# EasyEDA Pro project 3SE_24_Power_Rune.eprj, board Armour (continued)
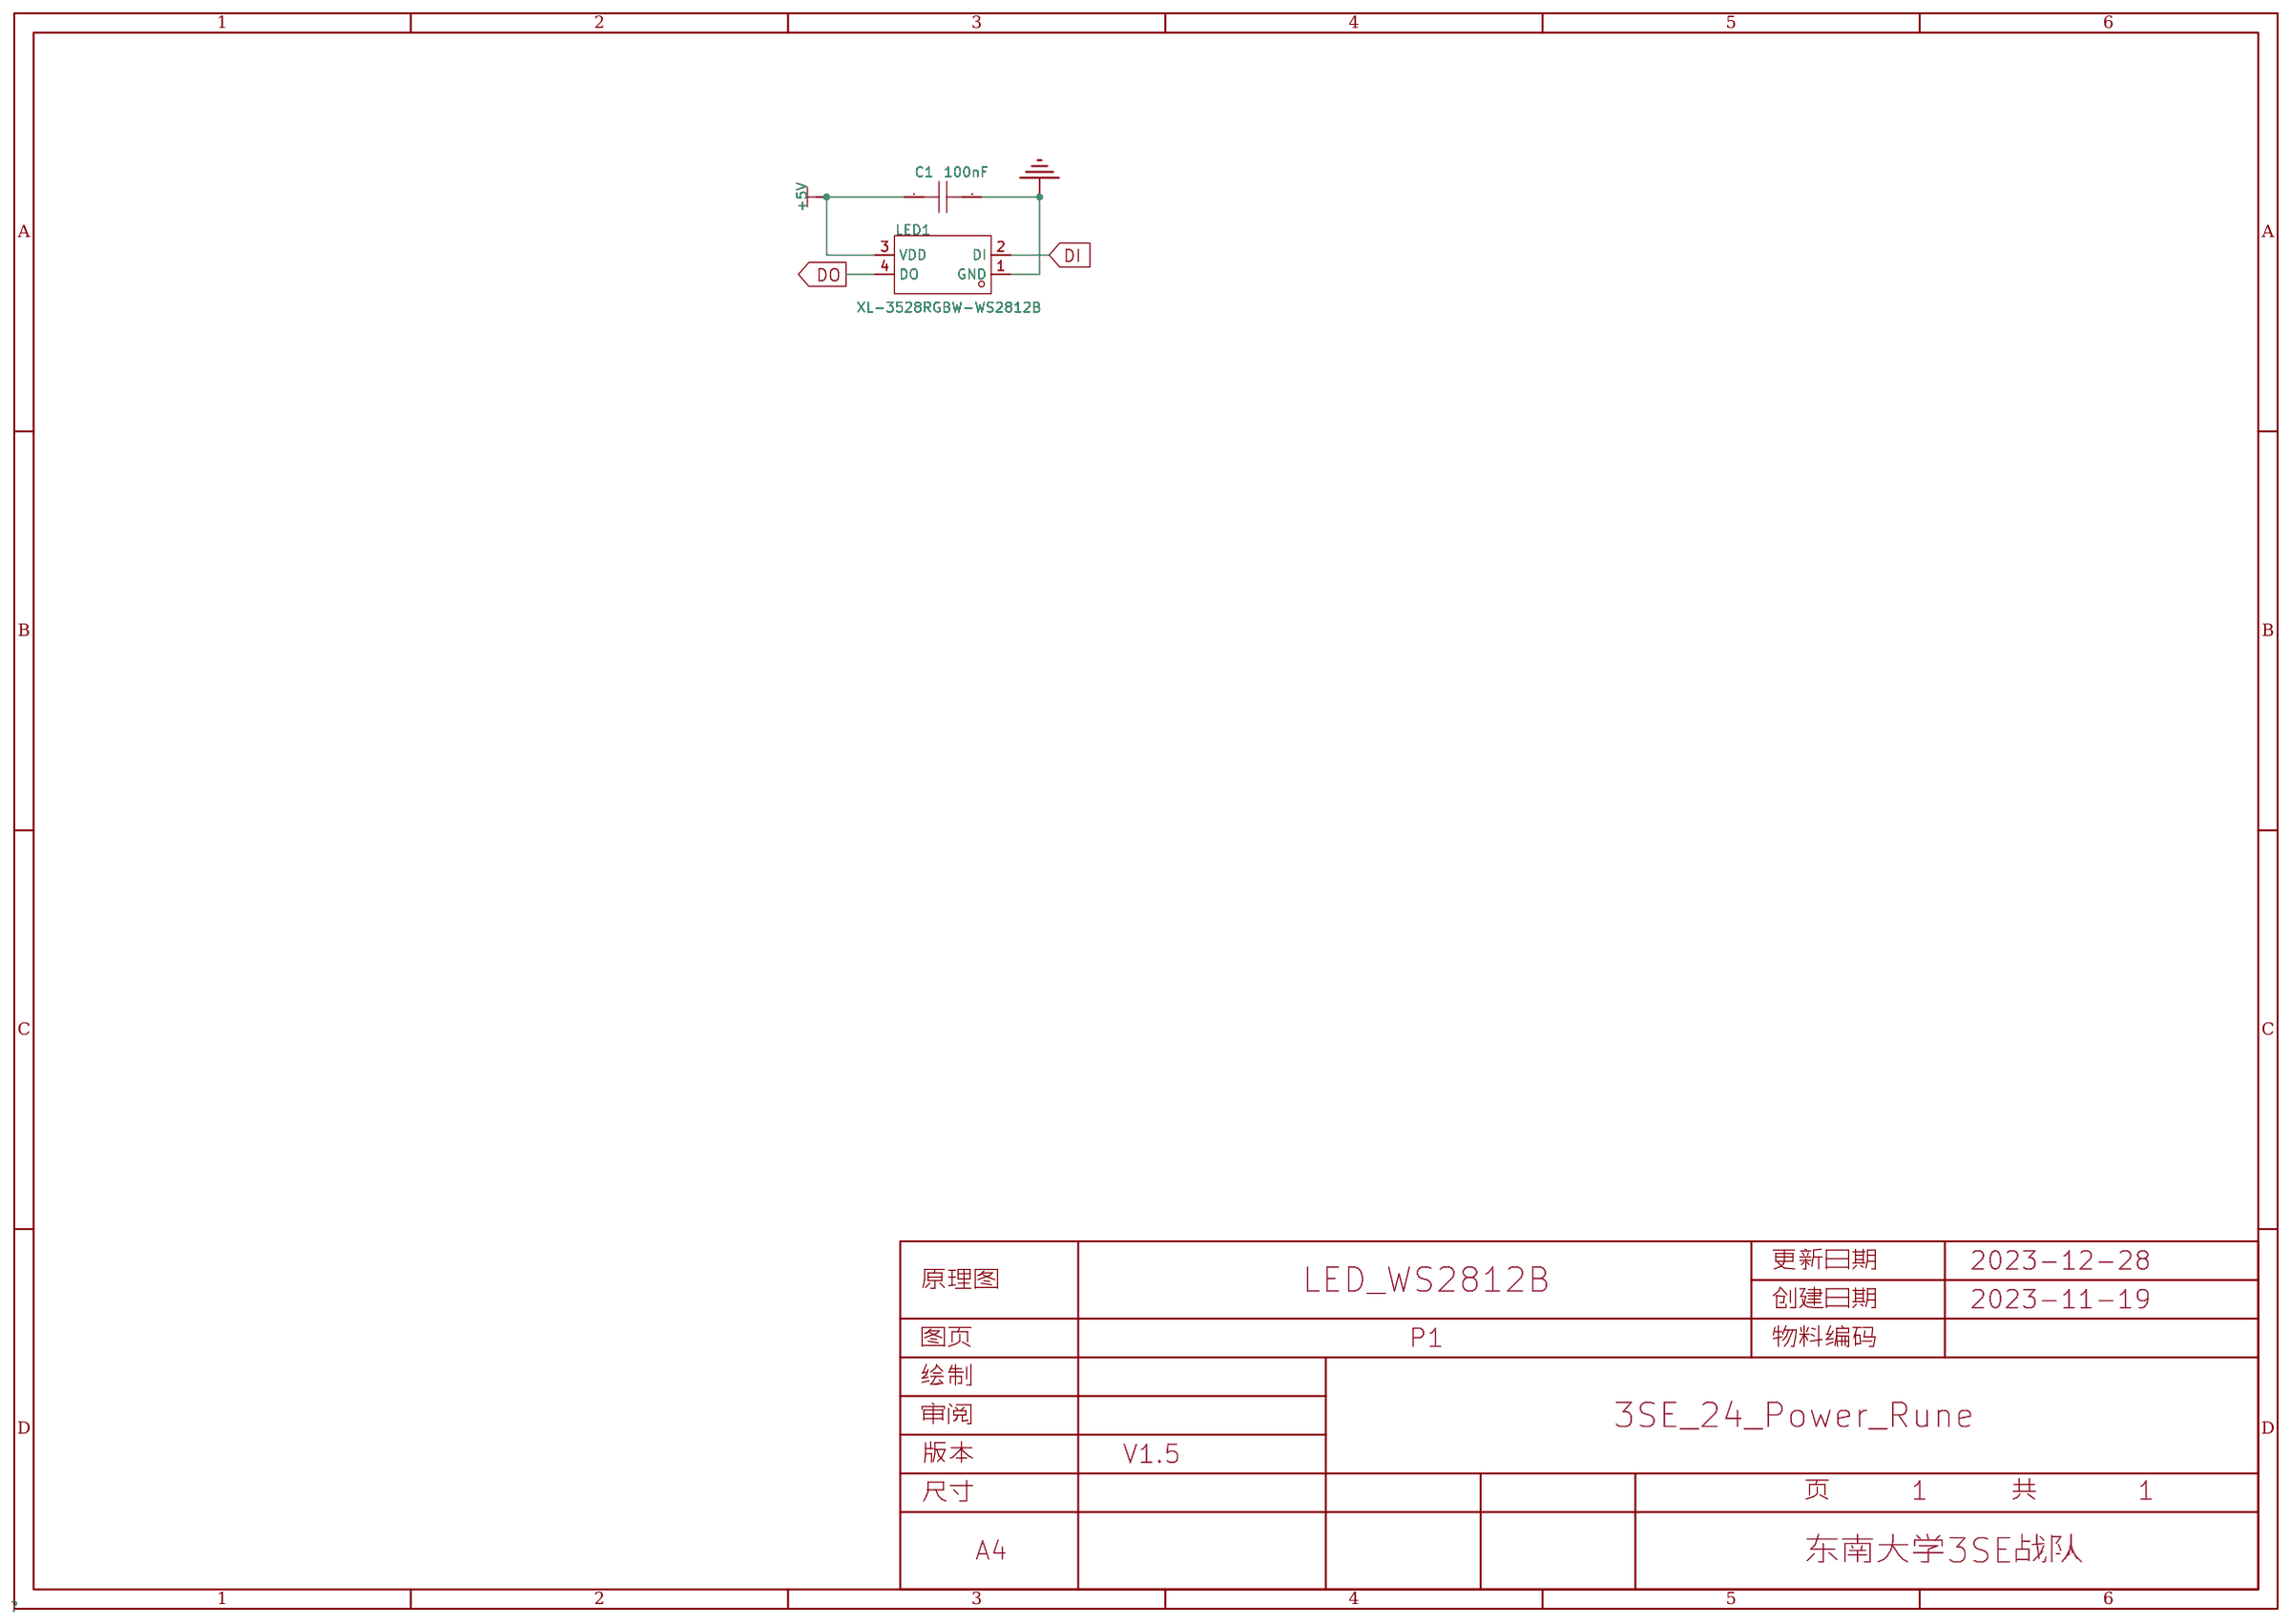
[diagram p0: schematic sheet]
## Nets (continued)
$1N31567: LED211.4 LED212.2
$1N31571: LED210.4 LED211.2
$1N31573: LED214.4 LED215.2
$1N31574: LED215.4 LED216.2
$1N31575: LED213.4 LED214.2
$1N31715: LED218.4 LED219.2
$1N31717: LED220.4 LED221.2
$1N31718: LED221.4 LED222.2
$1N31721: LED219.4 LED220.2
$1N31723: LED223.4 LED224.2
$1N31724: LED224.4 LED225.2
$1N31727: LED216.4 LED217.2
$1N31863: LED226.4 LED227.2
$1N31867: LED229.4 LED230.2
$1N31868: LED230.4 LED231.2
$1N31869: LED231.4 LED232.2
$1N31871: LED228.4 LED229.2
$1N31874: LED233.4 LED234.2
$1N31877: LED225.4 LED226.2
$1N32013: LED235.4 LED236.2
$1N32014: LED236.4 LED237.2
$1N32015: LED237.4 LED238.2
$1N32017: LED239.4 LED240.2
$1N32018: LED240.4 LED241.2
$1N32019: LED241.4 LED242.2
$1N32021: LED238.4 LED239.2
$1N32023: LED243.4 LED244.2
$1N32024: LED244.4 LED245.2
$1N32025: LED242.4 LED243.2
$1N32027: LED234.4 LED235.2
$1N32163: LED246.4 LED247.2
$1N32164: LED247.4 LED248.2
$1N32165: LED248.4 LED249.2
$1N32167: LED250.4 LED251.2
$1N32168: LED251.4 LED252.2
$1N32169: LED252.4 LED253.2
$1N32171: LED249.4 LED250.2
$1N32173: LED254.4 LED255.2
$1N32174: LED255.4 LED256.2
$1N32175: LED253.4 LED254.2
$1N32177: LED245.4 LED246.2
$1N32313: LED257.4 LED258.2
$1N32327: LED256.4 LED257.2
$1N36301: LED217.4 LED218.2
$1N36307: LED222.4 LED223.2
$1N36310: LED227.4 LED228.2
$1N36313: LED232.4 LED233.2
$1N36316: LED197.4 LED198.2
$1N36322: LED202.4 LED203.2
$1N36325: LED207.4 LED208.2
$1N36331: LED212.4 LED213.2
$1N36334: LED70.4 LED71.2
$1N36337: LED80.4 LED81.2
$1N36340: LED54.4 LED55.2
$1N36343: LED3.4 LED4.2
$1N36346: LED8.4 LED9.2
$1N36349: LED13.4 LED14.2
$1N36354: LED23.4 LED24.2
$1N36357: LED18.4 LED19.2
$1N36363: LED28.4 LED29.2
$1N36372: LED33.4 LED34.2
$1N36387: LED38.4 LED39.2
$11N923: R28.2 U3.15
$11N2441: C438.1 R1.1 R6.2 U1.2
$11N5632: C452.1 U3.8 X1.1
$11N5639: C454.1 U3.9 X1.2
$11N5674: SW3.2 U3.21
$11N5844: LED431.2 R30.1
$11N5848: LED431.1 U3.25
$11N11553: R32.2 USB1.4
$11N11554: R33.2 USB1.10
$11N31259: D2.2 L1.1 U1.3
$11N48563: C433.1 U1.4
$11N53990: D4.3 USB1.6 USB1.8
$11N54016: D4.1 USB1.5 USB1.7
$12N59: LED259.4 LED260.2
$12N73: LED260.4 LED261.2
$12N87: LED261.4 LED262.2
$12N101: LED262.4 LED263.2
$12N115: LED263.4 LED264.2
$12N129: LED264.4 LED265.2
$12N143: LED265.4 LED266.2
$12N157: LED266.4 LED267.2
$12N171: LED267.4 LED268.2
$12N306: LED269.4 LED270.2
$12N308: LED270.4 LED271.2
$12N310: LED271.4 LED272.2
$12N312: LED272.4 LED273.2
$12N314: LED273.4 LED274.2
$12N316: LED274.4 LED275.2
$12N318: LED275.4 LED276.2
$12N320: LED276.4 LED277.2
$12N322: LED277.4 LED278.2
$12N702: LED279.4 LED280.2
$12N704: LED280.4 LED281.2
$12N706: LED281.4 LED282.2
$12N708: LED282.4 LED283.2
$12N710: LED283.4 LED284.2
$12N712: LED284.4 LED285.2
$12N714: LED285.4 LED286.2
$12N716: LED286.4 LED287.2
$12N718: LED287.4 LED288.2
$12N720: LED289.4 LED290.2
$12N722: LED290.4 LED291.2
$12N724: LED291.4 LED292.2
$12N726: LED292.4 LED293.2
$12N728: LED293.4 LED294.2
$12N730: LED294.4 LED295.2
$12N732: LED295.4 LED296.2
$12N734: LED296.4 LED297.2
$12N736: LED297.4 LED298.2
$12N978: LED299.4 LED300.2
$12N980: LED300.4 LED301.2
$12N982: LED301.4 LED302.2
$12N984: LED302.4 LED303.2
$12N986: LED303.4 LED304.2
$12N988: LED304.4 LED305.2
$12N990: LED305.4 LED306.2
$12N992: LED306.4 LED307.2
$12N994: LED307.4 LED308.2
$12N996: LED309.4 LED310.2
$12N998: LED310.4 LED311.2
$12N1000: LED311.4 LED312.2
$12N1002: LED312.4 LED313.2
$12N1004: LED313.4 LED314.2
$12N1006: LED314.4 LED315.2
$12N1008: LED315.4 LED316.2
$12N1010: LED316.4 LED317.2
$12N1012: LED317.4 LED318.2
$12N1254: LED319.4 LED320.2
$12N1256: LED320.4 LED321.2
$12N1258: LED321.4 LED322.2
$12N1260: LED322.4 LED323.2
$12N1262: LED323.4 LED324.2
$12N1264: LED324.4 LED325.2
$12N1266: LED325.4 LED326.2
$12N1268: LED326.4 LED327.2
$12N1270: LED327.4 LED328.2
$12N1272: LED329.4 LED330.2
$12N1274: LED330.4 LED331.2
$12N1276: LED331.4 LED332.2
$12N1278: LED332.4 LED333.2
$12N1280: LED333.4 LED334.2
$12N1282: LED334.4 LED335.2
$12N1284: LED335.4 LED336.2
$12N1286: LED336.4 LED337.2
$12N1288: LED337.4 LED338.2
$12N1638: LED339.4 LED340.2
$12N1640: LED340.4 LED341.2
$12N1642: LED341.4 LED342.2
$12N1644: LED342.4 LED343.2
$12N1646: LED343.4 LED344.2
$12N1648: LED338.4 LED339.2
$12N1652: LED268.4 LED269.2
$12N1662: LED278.4 LED279.2
$12N1671: LED288.4 LED289.2
$12N1676: LED298.4 LED299.2
$12N1681: LED308.4 LED309.2
$12N1691: LED318.4 LED319.2
$12N1696: LED328.4 LED329.2
$12N3097: LED345.4 LED346.2
$12N3099: LED346.4 LED347.2
$12N3101: LED347.4 LED348.2
$12N3103: LED348.4 LED349.2
$12N3105: LED349.4 LED350.2
$12N3107: LED350.4 LED351.2
$12N3109: LED351.4 LED352.2
$12N3111: LED352.4 LED353.2
$12N3113: LED353.4 LED354.2
$12N3115: LED355.4 LED356.2
$12N3117: LED356.4 LED357.2
$12N3119: LED357.4 LED358.2
$12N3121: LED358.4 LED359.2
$12N3123: LED359.4 LED360.2
$12N3125: LED360.4 LED361.2
$12N3127: LED361.4 LED362.2
$12N3129: LED362.4 LED363.2
$12N3131: LED363.4 LED364.2
$12N3133: LED365.4 LED366.2
$12N3135: LED366.4 LED367.2
$12N3137: LED367.4 LED368.2
$12N3139: LED368.4 LED369.2
$12N3141: LED369.4 LED370.2
$12N3143: LED370.4 LED371.2
$12N3145: LED371.4 LED372.2
$12N3147: LED372.4 LED373.2
$12N3149: LED373.4 LED374.2
$12N3151: LED375.4 LED376.2
$12N3153: LED376.4 LED377.2
$12N3155: LED377.4 LED378.2
$12N3157: LED378.4 LED379.2
$12N3159: LED379.4 LED380.2
$12N3161: LED380.4 LED381.2
$12N3163: LED381.4 LED382.2
$12N3165: LED382.4 LED383.2
$12N3167: LED383.4 LED384.2
$12N3169: LED385.4 LED386.2
$12N3171: LED386.4 LED387.2
$12N3173: LED387.4 LED388.2
$12N3175: LED388.4 LED389.2
$12N3177: LED389.4 LED390.2
$12N3179: LED390.4 LED391.2
$12N3181: LED391.4 LED392.2
$12N3183: LED392.4 LED393.2
$12N3185: LED393.4 LED394.2
$12N3187: LED395.4 LED396.2
$12N3189: LED396.4 LED397.2
$12N3191: LED397.4 LED398.2
$12N3193: LED398.4 LED399.2
$12N3195: LED399.4 LED400.2
$12N3197: LED400.4 LED401.2
$12N3199: LED401.4 LED402.2
$12N3201: LED402.4 LED403.2
$12N3203: LED403.4 LED404.2
$12N3205: LED405.4 LED406.2
$12N3207: LED406.4 LED407.2
$12N3209: LED407.4 LED408.2
$12N3211: LED408.4 LED409.2
$12N3213: LED409.4 LED410.2
$12N3215: LED410.4 LED411.2
$12N3217: LED411.4 LED412.2
$12N3219: LED412.4 LED413.2
$12N3221: LED413.4 LED414.2
$12N3223: LED415.4 LED416.2
$12N3227: LED417.4 LED418.2
$12N3229: LED418.4 LED419.2
$12N3231: LED419.4 LED420.2
$12N3233: LED420.4 LED421.2
$12N3235: LED421.4 LED422.2
$12N3237: LED422.4 LED423.2
$12N3239: LED423.4 LED424.2
$12N3241: LED425.4 LED426.2
$12N3243: LED426.4 LED427.2
$12N3245: LED427.4 LED428.2
$12N3247: LED428.4 LED429.2
$12N3249: LED429.4 LED430.2
$12N3253: LED354.4 LED355.2
$12N3257: LED364.4 LED365.2
$12N3261: LED374.4 LED375.2
$12N3265: LED384.4 LED385.2
$12N3269: LED394.4 LED395.2
$12N3273: LED404.4 LED405.2
$12N3277: LED414.4 LED415.2
$12N3291: LED424.4 LED425.2
$12N3294: LED416.4 LED417.2
$12N6150: LED432.4 LED433.2
$12N6151: LED433.4 LED434.2
$12N6152: LED430.4 LED432.2
$12N6190: LED435.4 LED436.2
$12N6191: LED436.4 LED437.2
$12N6192: LED434.4 LED435.2

Pads without a net: CN3 3; U1 6; U3 10 11 16 24 26 28 29 30 32 33 34 35; U4 2 4 5; USB1 3 9

## Via types
v1: diameter 0.61, hole 0.305, Top Layer to Bottom Layer, 796 vias

## Routing (per net, layer and track width the routed paths; a pad name or vN(x,y) marks a point on that pad's centre or on a via; arc(x,y) is an arc through that point)
+3V3: length 77.7
  Top Layer w0.128: R14.2 338.89,214.65 335.4,214.65 335.28,214.78
  Top Layer w0.254: R5.2 329.55,230.93 v1(329.56,230.92) ; 325.82,228.64 328.09,228.64 328.13,228.68 ; 325.82,228.64 325.82,227.94 ; 325.82,228.64 325.82,229.35 R8.2 ; v1(333.71,229.73) 339.77,229.73 v1(341.91,231.87) v1(346.13,236.09) ; v1(351.6,238.2) 351.6,237.2 R2.2 ; 330.51,233.68 330.51,234.15 C446.1 ; v1(342.6,195.69) 346.75,195.69 347.16,195.29 347.16,192.9 346.91,192.64 346.23,192.64 345.32,191.74 R31.1 ; R18.1 328.9,233.52 328.74,233.68 328.78,233.72 C445.1 ; v1(335.28,214.79) 335.28,214.78 R26.2 ; 336.32,197.97 336.32,198.43 U4.16 ; 336.32,197.97 336.36,197.93 v1(336.36,197.31) ; 336.32,197.97 C448.1 ; R11.2 328.13,228.68 ; 328.13,228.68 328.12,228.68 ; v1(332.43,216.38) 332.43,215.56 R28.1 ; v1(328.06,221.1) R25.2 ; 339.82,210.81 339.81,210.83 C435.2 338.36,210.81 v1(337.48,210.81) 336.72,210.81 C434.1
  Top Layer w0.5: v1(327.82,233.67) 328.73,233.67 328.74,233.68 332.36,233.68 332.38,233.69
  Bottom Layer w0.127: 341.91,231.88 341.92,231.89 348.73,231.89 351.19,229.43 v1(351.56,229.43)
  Bottom Layer w0.254: v1(328.06,221.1) 332.38,221.1 332.43,221.15 ; v1(346.13,236.09) 350.59,236.09 351.6,237.1 v1(351.6,238.2) ; 331.88,226.99 330.97,226.99 329.15,228.8 v1(328.28,228.8)
  vias: v1(335.5,209.71) v1(335.53,208.77) v1(336.49,209.71) v1(336.49,208.77)
+5V: length 1001.1
  Top Layer w0.254: C48.1 v1(255.55,303.64) LED48.3 ; C350.1 v1(322.88,78.82) LED350.3 ; 137.48,37.56 v1(137.28,36.63) C414.1 ; LED354.3 v1(345.13,66.91) C354.1 ; LED416.3 v1(103.57,44.2) C416.1 ; LED156.3 v1(268.69,149.19) C156.1 ; LED254.3 v1(184.25,175.44) C254.1 ; LED312.3 v1(128.24,354.12) C312.1 ; LED36.3 v1(285.01,97.17) C36.1 ; LED402.3 v1(74.44,29.53) C402.1 ; LED153.3 v1(233,113.5) C153.1 ; LED411.3 v1(61.84,42.43) C411.1 ; LED27.3 v1(97.5,84.88) C27.1 ; LED135.3 v1(135.5,282.37) C135.1 ; C196.1 v1(249.45,215.41) LED196.3 ; C430.1 v1(29.07,92.55) LED430.3 ; C101.1 v1(80.1,228.69) LED101.3 ; LED76.3 v1(241.96,84.22) C76.1 ; C24.1 v1(60.84,126.69) LED24.3 ; C121.1 v1(291.47,163.8) LED121.3 ; LED100.3 v1(84.32,249.56) C100.1 ; LED422.3 v1(14.74,80.23) 13.98,81.06 ; LED435.3 v1(35,118.41) C461.1 ; LED391.3 v1(179.79,22.38) C391.1 ; LED99.3 v1(93.23,264.06) C99.1 ; LED262.3 v1(326.31,309.26) C262.1 ; LED126.3 v1(268.69,246.69) C126.1 ; LED91.3 v1(217.72,305.36) C91.1 ; C380.1 v1(279.18,45.39) LED380.3 ; LED47.3 v1(269.56,292.69) C47.1 ; C136.1 v1(121.58,272.62) LED136.3 ; C147.1 v1(135.5,113.5) LED147.3 ; LED326.3 v1(42.65,336.77) C326.1 ; 338.92,35.93 v1(339.55,36.87) LED361.3 ; C293.1 v1(222.38,359.93) LED293.3 ; LED396.3 v1(167.21,32.38) C396.1 ; LED35.3 v1(271,84.88) C35.1 ; LED120.3 v1(287.18,142.72) C120.1 ; LED125.3 v1(280.58,222.56) C125.1 ; C236.1 v1(220.34,213) LED236.3 ; C60.1 v1(66.23,234.65) LED60.3 ; 332.51,70.07 v1(333.4,69.73) C353.1 ; C344.1 v1(27.36,263.8) LED344.3 ; LED366.3 v1(253.67,19.91) C366.1 ; LED83.3 v1(296.75,197.94) C83.1 ; LED96.3 v1(135.28,294.3) C96.1 ; LED225.3 v1(131.75,197.94) C225.1 ; LED382.3 v1(249.76,39.52) C382.1 ; 187.25,183.14 v1(187.25,182.19) C255.1 ; C460.1 v1(39.86,104.22) LED434.3 ; LED377.3 v1(320.11,54.31) 319.48,53.37 ; 245.19,354.94 v1(244.9,354.03) 243.9,353.51 ; LED315.3 v1(87.91,342.4) C315.1 ; C173.1 v1(121.64,245.83) LED173.3 ; LED103.3 v1(71.75,197.94) C103.1 ; LED110.3 v1(131.86,98.33) C110.1 ; 313.72,342.32 v1(314.72,342.84) 315.01,343.75 ; 334.01,348.27 v1(333.72,347.37) 332.72,346.85 ; LED15.3 v1(97.5,310.99) C15.1 ; C66.1 v1(71.67,138.08) LED66.3 ; C178.1 v1(103,183.61) LED178.3 ; LED420.3 v1(49.25,55.32) 48.3,54.71 ; LED16.3 v1(83.49,298.7) C16.1 ; C73.1 v1(188.7,70.51) LED73.3 ; LED143.3 v1(90.8,170.1) C143.1 ; LED360.3 v1(353.41,137.04) C360.1 ; C209.1 v1(166.78,132.74) LED209.3 ; 354.17,78.76 v1(355.01,77.99) LED356.3 ; C371.1 v1(295.85,38.52) LED371.3 ; LED240.3 v1(154.43,213.5) C240.1 ; 328.52,335.91 v1(329.52,336.43) 329.81,337.33 ; LED42.3 v1(313.47,212.31) C42.1 ; C244.1 v1(184.25,160.44) LED244.3 ; LED12.3 v1(165.65,339.22) C12.1 ; C58.1 v1(81.1,272.88) LED58.3 ; C201.1 v1(166.78,263.13) LED201.3 ; 303.31,356.02 v1(304.31,356.54) 304.6,357.44 ; LED359.3 v1(353.79,122.97) C359.1 ; C188.1 v1(212.47,120.41) LED188.3 ; 327.17,93.22 v1(328.06,92.9) C349.1 ; LED82.3 v1(310.51,180.19) C82.1 ; C311.1 v1(141.69,358.03) LED311.3 ; LED232.3 v1(210.5,152.47) C232.1 ; C203.1 v1(125.79,231.69) LED203.3 ; 266.24,33.58 v1(266.43,32.65) 265.8,31.71 ; C329.1 v1(109.22,369.42) LED329.3 ; LED149.3 v1(167.32,101.92) C149.1 ; C2.1 v1(325.53,216.54) LED2.3 ; LED63.3 v1(57.06,189.04) C63.1 ; C221.1 v1(170.66,248.65) LED221.3 ; LED7.3 v1(271,310.99) C7.1 ; LED134.3 v1(156.64,291.26) C134.1 ; LED205.3 v1(116.75,197.94) C205.1 ; LED397.3 148,14.15 v1(147.8,13.95) C397.1 ; C385.1 v1(207.2,12.38) LED385.3 ; C220.1 v1(184.25,250.44) LED220.3 ; 276.57,364.32 v1(277.57,364.84) 277.86,365.74 ; C268.1 v1(334.31,322.88) 335.25,323.03 ; LED129.3 v1(233,282.37) C129.1 ; LED159.3 v1(266.75,197.94) C159.1 ; C14.1 v1(113,321.34) LED14.3 ; C324.1 v1(71.68,348.1) 71.41,349.01 ; 124.91,362.74 v1(125.45,363.73) LED320.3 ; LED176.3 v1(103,212.26) C176.1 ; C404.1 v1(34.44,38.6) LED404.3 ; LED238.3 v1(184.25,235.44) C238.1 ; LED309.3 v1(166.38,379.93) C309.1 ; C223.1 v1(138.78,224.19) LED223.3 ; C387.1 v1(179.79,12.38) LED387.3 ; LED365.3 v1(268.38,22.84) 267.76,21.9 ; 298.68,338.34 v1(298.39,337.44) 297.38,336.92 ; LED51.3 v1(206.39,323.5) C51.1 ; C108.1 v1(104.7,118.39) LED108.3 ; C313.1 v1(114.8,350.22) LED313.3 ; C194.1 v1(265.5,183.61) LED194.3 ; LED294.3 v1(208.38,359.93) C294.1 ; C56.1 v1(105.75,298.41) LED56.3 ; C3.1 v1(321.89,234.82) LED3.3 ; LED318.3 v1(50.94,329.63) C318.1 ; LED393.3 v1(207.2,32.38) C393.1 ; LED184.3 v1(156.03,120.41) C184.1 ; C195.1 v1(251.75,197.94) LED195.3 ; LED170.3 v1(156.03,275.46) C170.1 ; C222.1 v1(157.47,242.83) LED222.3 ; C423.1 v1(15.42,95.21) LED423.3 ; C384.1 v1(220.34,33.66) LED384.3 ; 151.01,32.9 v1(151.96,33.51) LED413.3 ; LED148.3 v1(159.33,101.09) C148.1 ; LED215.3 v1(236.75,197.94) C215.1 ; C72.1 v1(170.92,71.13) LED72.3 ; 167.45,309.85 v1(166.65,309.05) LED94.3 ; 224.45,319.99 224.45,319.86 v1(223.78,319.19) 223.78,318.38 223.65,318.25 ; 261.53,360.34 v1(261.24,359.43) 260.23,358.91 ; LED179.3 v1(106.72,169.72) C179.1 ; C231.1 v1(197.84,147.22) LED231.3 ; 21.55,34.65 21.55,36.73 22.88,38.06 v1(22.88,40.28) ; C392.1 v1(167.21,22.38) LED392.3 ; C226.1 v1(133.54,184.35) LED226.3 ; 60.48,333.6 v1(61.03,334.59) LED317.3 ; LED95.3 v1(150.31,305.19) C95.1 ; 16.03,126.01 v1(16.79,125.18) LED425.3 ; LED308.3 v1(180.38,379.93) C308.1 ; LED165.3 v1(225.5,269.38) C165.1 ; C177.1 v1(101.75,197.94) LED177.3 ; C117.1 v1(250.38,106.92) LED117.3 ; LED342.3 v1(32.8,293.3) C342.1 ; LED216.3 v1(234.96,211.52) C216.1 ; LED433.3 v1(44.71,90.03) C459.1 ; LED21.3 v1(41.75,197.94) C21.1 ; C367.1 v1(238.96,16.98) LED367.3 ; 310.75,332.77 v1(311.76,333.29) 312.05,334.19 ; C118.1 v1(263.8,118.39) LED118.3 ; LED140.3 v1(88.23,214.87) C140.1 ; LED169.3 v1(169.92,279.18) C169.1 ; LED28.3 v1(113,74.53) C28.1 ; C62.1 v1(57.06,206.83) LED62.3 ; C357.1 v1(354.6,92.98) 355.55,93.03 ; C144.1 v1(99.81,149.19) LED144.3 ; LED80.3 v1(292.38,130.37) C80.1 ; LED386.3 v1(194.79,12.38) C386.1 ; LED11.3 v1(184.25,340.44) C11.1 ; C306.1 v1(208.38,379.93) LED306.3 ; LED8.3 v1(255.5,321.34) C8.1 ; 300.35,346.47 v1(301.35,346.99) 301.64,347.89 ; LED212.3 v1(218,139.48) C212.1 ; 273.6,354.77 v1(274.61,355.29) 274.9,356.19 ; LED104.3 v1(73.13,180.34) C104.1 ; LED13.3 v1(147.37,335.58) C13.1 ; LED307.3 v1(194.38,379.93) C307.1 ; v1(319.19,231.22) 319.19,228.89 v1(319.12,228.81) 319.17,228.77 v1(319.17,226.56) ; C78.1 v1(269.56,103.18) LED78.3 ; C403.1 v1(59.76,32.65) LED403.3 ; C79.1 v1(280.9,114.34) LED79.3 ; C107.1 v1(93.23,131.81) LED107.3 ; C65.1 v1(63.07,158.37) LED65.3 ; C370.1 v1(310.56,41.45) 310.37,42.38 ; 224.07,14.98 v1(224.25,14.04) C368.1 ; 138.63,368.55 v1(138.9,367.63) C319.1 ; C256.1 v1(195.96,197.92) 195.96,196.97 ; C228.1 v1(155.82,152.67) LED228.3 ; LED263.3 v1(324.45,321.25) C263.1 ; C69.1 105.7,99.13 v1(104.92,98.36) LED69.3 ; 297.62,29.64 v1(297.8,28.71) 297.18,27.77 ; CN6.4 348.53,251.17 v1(348.44,251.17) ; LED415.3 v1(122.61,39.75) C415.1 ; C249.1 v1(195.5,217.42) LED249.3 ; C364.1 v1(283.09,25.78) 282.91,26.71 ; LED258.3 v1(174.96,194.52) C258.1 ; LED265.3 v1(341.65,278.48) C265.1 ; LED97.3 v1(118.12,288.95) C97.1 ; C426.1 v1(17.48,140.16) 18.43,140.12 ; LED75.3 v1(226.9,73.4) C75.1 ; 64.12,53.14 v1(63.92,52.21) 62.97,51.59 ; 234.42,35.65 v1(235.05,36.59) LED383.3 ; C421.1 v1(14.05,65.24) LED421.3 ; 236.45,376.76 v1(237.46,377.28) 237.75,378.19 ; 44.49,303.82 v1(45.42,303.65) C336.1 ; v1(346.15,210.35) v1(346.95,210.35) ; LED340.3 v1(38.24,322.81) C340.1 ; LED18.3 v1(60.84,269.19) C18.1 ; C208.1 v1(150.5,139.48) LED208.3 ; C39.1 v1(321.89,161.05) LED39.3 ; LED137.3 v1(109.56,260.61) C137.1 ; LED123.3 v1(281.75,197.94) C123.1 ; 270.64,345.22 v1(271.65,345.73) 271.93,346.64 ; LED246.3 v1(216.73,179.19) C246.1 ; C31.1 v1(184.25,55.44) LED31.3 ; C296.1 v1(180.38,359.93) LED296.3 ; LED389.3 v1(207.2,22.38) C389.1 ; LED230.3 v1(184.25,145.44) C230.1 ; C218.1 v1(210.5,243.4) LED218.3 ; LED211.3 v1(201.72,132.74) C211.1 ; 320.67,330.42 v1(320.38,329.51) 319.38,328.99 ; 264.49,369.89 v1(264.2,368.98) 263.19,368.47 ; LED237.3 v1(202.64,230.62) C237.1 ; C406.1 v1(135.21,26.85) LED406.3 ; C429.1 v1(29.52,79.67) LED429.3 ; 135.56,376.25 v1(136.11,377.24) LED327.3 ; LED4.3 v1(307.66,269.19) C4.1 ; C250.1 v1(184.25,220.44) LED250.3 ; LED298.3 v1(152.38,359.93) C298.1 ; LED54.3 v1(152.72,321.04) 153.52,321.84 ; C224.1 v1(133.54,211.52) LED224.3 ; C214.1 v1(249.45,180.46) LED214.3 ; LED44.3 v1(297.9,255.68) C44.1 ; C394.1 v1(194.79,32.38) LED394.3 ; C189.1 v1(225.5,126.49) LED189.3 ; LED32.3 v1(202.85,56.65) C32.1 ; C204.1 v1(119.05,215.41) LED204.3 ; 230.53,357.66 v1(231.53,358.18) 231.82,359.08 ; LED427.3 v1(25.41,63.98) C427.1 ; C267.1 v1(336.76,308.08) LED267.3 ; C252.1 v1(164.76,186.69) LED252.3 ; 353.36,108.74 v1(354.19,107.98) LED358.3 ; LED33.3 v1(221.13,60.29) C33.1 ; C74.1 v1(206.39,72.37) LED74.3 ; LED164.3 v1(234.84,263.18) C164.1 ; C399.1 v1(118.46,20.18) LED399.3 ; LED161.3 v1(261.77,226.15) C161.1 ; C463.1 v1(25.29,146.8) LED437.3 ; 316.68,351.87 v1(317.69,352.39) 317.97,353.3 ; v1(282.82,224.6) 282.82,225.72 280.73,227.81 v1(280.73,229.17) ; LED77.3 v1(255.55,92.23) C77.1 ; C199.1 v1(201.72,263.13) LED199.3 ; C132.1 v1(184.25,295.44) LED132.3 ; LED180.3 v1(112.8,156.69) C180.1 ; LED338.3 v1(39.92,276.74) 40.56,275.81 ; LED43.3 v1(306.81,233.08) C43.1 ; C25.1 v1(71.2,111.19) LED25.3 ; LED330.3 v1(95.78,365.52) C330.1 ; C111.1 v1(153.5,87.2) LED111.3 ; LED193.3 v1(261.77,169.72) C193.1 ; C334.1 v1(38.35,348.88) LED334.3 ; 291.23,361.59 v1(290.94,360.69) 289.94,360.17 ; C300.1 v1(208.38,369.93) LED300.3 ; C234.1 v1(234.96,184.35) LED234.3 ; LED251.3 v1(164.72,194.53) C251.1 ; LED213.3 v1(242.71,164.19) C213.1 ; LED57.3 v1(92.53,286.5) C57.1 ; LED260.3 v1(331.78,276.85) C260.1 ; LED34.3 v1(255.5,74.53) C34.1 ; C59.1 v1(71.67,257.79) LED59.3 ; LED49.3 v1(245.04,308.16) C49.1 ; C401.1 v1(89.11,26.41) LED401.3 ; LED412.3 v1(43.01,46.42) C412.1 ; C68.1 v1(92.53,109.37) LED68.3 ; C166.1 v1(212.47,275.46) LED166.3 ; C17.1 v1(71.2,284.68) LED17.3 ; LED67.3 v1(81.1,122.99) C67.1 ; LED46.3 v1(281.92,279.89) C46.1 ; C109.1 v1(118.12,106.92) LED109.3 ; C345.1 v1(348.79,149.2) LED345.3 ; 76.71,40.24 v1(76.51,39.31) C410.1 ; C71.1 v1(153.4,74.22) LED71.3 ; C301.1 v1(194.38,369.93) LED301.3 ; LED341.3 v1(35.52,308.05) 36.16,307.12 ; LED362.3 v1(312.51,31.64) C362.1 ; C242.1 v1(151.5,179.46) LED242.3 ; C116.1 v1(236.21,98.16) LED116.3 ; 340.24,83.27 v1(341.13,82.93) C352.1 ; LED85.3 v1(294.46,228.56) C85.1 ; C89.1 v1(250.38,288.95) LED89.3 ; C186.1 v1(184.25,115.44) LED186.3 ; LED304.3 v1(152.38,369.93) C304.1 ; LED259.3 v1(334.23,262.05) C259.1 ; C390.1 v1(194.79,22.38) LED390.3 ; LED162.3 v1(255.7,239.19) C162.1 ; C10.1 v1(202.85,339.22) LED10.3 ; C45.1 v1(292.38,265.5) 292.38,264.55 ; C372.1 v1(281.14,35.58) LED372.3 ; LED321.3 v1(112.01,359.82) C321.1 ; C61.1 v1(59.54,224.44) 59.54,223.49 ; C183.1 v1(143,126.49) LED183.3 ; LED158.3 v1(280.27,181) 281.07,181.8 282.26,183 284.53,183 285.85,181.68 285.85,178.56 278.36,171.08 C157.1 v1(277.56,169.6) LED157.3 ; LED245.3 v1(205.84,161.69) C245.1 ; LED398.3 v1(133.13,17.07) 132.18,16.45 ; C138.1 v1(99.81,246.69) LED138.3 ; C339.1 v1(37.19,261.99) 36.26,262.16 ; C9.1 v1(221.13,335.58) LED9.3 ; LED428.3 v1(38.44,65.7) C428.1 ; LED192.3 v1(255.7,156.69) C192.1 ; LED145.3 v1(109.56,135.26) C145.1 ; C210.1 v1(184.25,130.44) LED210.3 ; C93.1 v1(184.25,310.44) LED93.3 ; C86.1 v1(283.98,250.02) LED86.3 ; LED347.3 v1(338.42,121.05) C347.1 ; LED40.3 v1(325.53,179.34) C40.1 ; LED102.3 v1(73.13,215.53) C102.1 ; C155.1 v1(258.94,135.26) LED155.3 ; LED325.3 v1(58.23,344.19) C325.1 ; LED5.3 v1(297.3,284.68) C5.1 ; v1(347.42,38) 347.47,37.95 347.47,34.14 ; C55.1 v1(120.5,308.35) LED55.3 ; C30.1 v1(165.65,56.65) LED30.3 ; LED187.3 v1(198.58,116.69) C187.1 ; 184.26,209.46 v1(184.26,210.41) C257.1 ; C395.1 v1(179.79,32.38) LED395.3 ; C241.1 v1(149.75,194.57) LED241.3 ; LED235.3 v1(221.75,197.94) C235.1 ; 248.15,364.49 v1(247.87,363.58) 246.86,363.06 ; C418.1 v1(78.59,49.09) LED418.3 ; C131.1 v1(201.18,293.95) LED131.3 ; LED369.3 v1(328.35,45.22) 327.72,44.28 ; LED127.3 v1(258.94,260.61) C127.1 ; LED128.3 v1(246.92,272.62) C128.1 ; C139.1 v1(93.97,222.84) LED139.3 ; LED19.3 v1(46.6,234.82) C19.1 ; LED328.3 v1(122.66,373.33) C328.1 ; LED436.3 v1(30.14,132.6) C462.1 ; LED303.3 v1(166.38,369.93) C303.1 ; 342.71,135.45 v1(343.6,135.13) C346.1 ; 234.78,368.63 v1(234.49,367.73) 233.49,367.21 ; C38.1 v1(307.66,126.69) LED38.3 ; C458.1 v1(49.57,75.84) LED432.3 ; C295.1 v1(194.38,359.93) LED295.3 ; C197.1 v1(242.71,231.69) LED197.3 ; C190.1 v1(238.61,129.36) LED190.3 ; 103.98,24.23 v1(103.78,23.3) C400.1 ; LED70.3 v1(120.5,87.52) C70.1 ; 42.97,178.39 v1(42.97,179.34) C22.1 ; LED119.3 v1(275.26,131.81) C119.1 ; C305.1 v1(222.38,379.93) LED305.3 ; C206.1 v1(119.05,180.46) LED206.3 ; 257.27,349.36 v1(258.27,349.88) 258.56,350.79 ; 218,255.44 v1(218,256.39) C198.1 ; 221.67,22.91 v1(222.3,23.85) LED376.3 ; C142.1 v1(88.23,181) LED142.3 ; C185.1 v1(169.92,116.69) LED185.3 ; C90.1 v1(239.31,294.25) LED90.3 ; LED53.3 v1(170.92,324.74) C53.1 ; 82.07,362.52 v1(82.33,361.61) 81.79,360.62 ; 338.28,293.94 v1(339.2,293.28) 340.14,293.43 ; 42.97,215.59 v1(42.97,216.54) C20.1 ; LED23.3 v1(46.6,161.05) C23.1 ; C182.1 v1(136.51,129.44) LED182.3 ; LED168.3 v1(184.25,280.44) C168.1 ; C160.1 v1(265.5,212.26) LED160.3 ; C374.1 v1(251.72,29.72) LED374.3 ; LED302.3 v1(180.38,369.93) C302.1 ; 249.82,372.61 v1(250.83,373.13) 251.12,374.04 ; LED133.3 v1(167.32,293.95) C133.1 ; 68.62,358.62 v1(68.89,357.7) C332.1 ; 308.42,52.19 v1(308.6,51.26) 307.98,50.31 ; 281.07,215.67 v1(280.27,214.87) LED124.3 ; LED337.3 v1(42.64,291.49) C337.1 ; LED152.3 v1(215.23,101.16) C152.1 ; LED310.3 v1(152.38,379.93) C310.1 ; LED141.3 v1(86.75,197.94) C141.1 ; LED375.3 v1(237.01,26.78) C375.1 ; 167.45,87.62 v1(166.65,86.82) LED112.3 ; C106.1 v1(87.42,142.62) LED106.3 ; C64.1 v1(59.54,171.43) LED64.3 ; C253.1 v1(173,178.45) LED253.3 ; LED37.3 v1(297.3,111.19) C37.1 ; D4.5 343.19,207.62 v1(343.78,207.62) ; LED81.3 v1(306.81,162.79) C81.1 ; C6.1 v1(285.01,298.7) LED6.3 ; C87.1 v1(275.26,264.06) LED87.3 ; 73.92,337.51 v1(74.47,338.5) LED316.3 ; C174.1 v1(112.8,239.19) LED174.3 ; LED52.3 v1(188.7,325.36) C52.1 ; LED351.3 v1(344.09,97.76) C351.1 ; LED163.3 v1(252.61,245.35) C163.1 ; C424.1 v1(16.11,110.19) LED424.3 ; C98.1 v1(104.7,277.48) LED98.3 ; C181.1 v1(118.77,147.08) LED181.3 ; C26.1 v1(83.49,97.17) LED26.3 ; LED243.3 v1(169.11,161.81) C243.1 ; LED1.3 v1(326.75,197.94) C1.1 ; LED167.3 v1(198.58,279.18) C167.1 ; C227.1 v1(138.78,171.69) LED227.3 ; C114.1 v1(201.85,86.82) LED114.3 ; C335.1 v1(48.08,320.99) LED335.3 ; C379.1 v1(293.89,48.32) 293.71,49.25 ; 119.58,29.35 119.92,29.35 v1(120.53,29.96) LED407.3 ; C154.1 v1(246.92,123.25) LED154.3 ; C322.1 v1(98.57,355.91) 98.3,356.83 ; LED122.3 v1(295.36,180.34) C122.1 ; C130.1 v1(211.92,291.43) LED130.3 ; LED333.3 v1(55.44,353.8) C333.1 ; 267.51,47.44 v1(266.89,46.5) LED381.3 ; C355.1 v1(355.41,63) LED355.3 ; C299.1 v1(222.38,369.93) LED299.3 ; LED261.3 v1(329.34,291.65) C261.1 ; LED348.3 v1(333.24,106.97) C348.1 ; C314.1 v1(101.36,346.31) LED314.3 ; C343.1 v1(30.08,278.55) LED343.3 ; C151.1 v1(201.18,101.92) LED151.3 ; C175.1 v1(106.72,226.15) LED175.3 ; LED233.3 v1(229.72,171.69) C233.1 ; C115.1 v1(220.9,87.2) LED115.3 ; 286.97,350.62 v1(287.98,351.14) 288.27,352.04 ; C229.1 v1(170.66,147.22) LED229.3 ; C388.1 v1(167.21,12.38) LED388.3 ; LED248.3 v1(203.74,209.19) C248.1 ; C88.1 v1(263.8,277.48) LED88.3 ; C207.1 v1(125.79,164.19) LED207.3 ; LED409.3 v1(91.19,36.19) C409.1 ; C113.1 v1(184.25,85.44) LED113.3 ; 284.01,341.07 v1(285.02,341.59) 285.31,342.49 ; 148.93,23.12 v1(149.88,23.73) 150.08,23.93 LED405.3 ; LED105.3 v1(76.9,164.24) C105.1 ; LED92.3 v1(201.85,309.05) C92.1 ; C408.1 105.24,32.46 v1(105.86,33.08) LED408.3 ; C146.1 v1(121.58,123.25) LED146.3 ; LED323.3 v1(85.12,352.01) C323.1 ; LED264.3 v1(344.1,263.68) C264.1 ; C217.1 v1(229.72,224.19) LED217.3 ; 311.75,196.99 311.85,197.09 v1(311.85,197.96) 312.55,198.66 312.55,198.74 ; LED191.3 v1(249.73,146.39) C191.1 ; C239.1 v1(165.5,230.41) LED239.3 ; LED297.3 v1(166.38,359.93) C297.1 ; C417.1 v1(93.26,45.98) LED417.3 ; LED29.3 v1(147.37,60.29) C29.1 ; LED247.3 v1(206.75,197.94) C247.1 ; v1(346.82,205.61) 346.13,205.61 v1(346.11,205.64) ; LED200.3 v1(184.25,265.44) C200.1 ; LED219.3 v1(197.84,248.65) C219.1 ; C150.1 v1(184.25,100.44) LED150.3 ; 150.5,255.44 v1(150.5,256.39) C202.1 ; C171.1 v1(143,269.38) LED171.3 ; C172.1 v1(133.5,262.55) LED172.3 ; C84.1 v1(295.36,215.53) LED84.3
  Top Layer w0.4: 37.19,188.47 37.1,188.38 ; R1.2 33.45,215.14 C438.2 37.03,211.56 37.03,188.59
  Top Layer w0.5: 331.64,203.75 332.12,203.75 333.2,202.68 339.18,202.68 340.15,203.65 344.12,203.65 v1(346.11,205.64) ; 347.99,205.56 347.94,205.62 v1(346.82,205.62) ; v1(346.95,210.35) 347.96,210.35 USB1.11
  Top Layer w0.78: v1(329.7,203.72) 331.6,203.72 331.64,203.75
  vias: v1(35.46,194.18) v1(35.46,192.18) v1(35.46,190.18) v1(35.46,188.18) v1(35.46,186.18) v1(35.46,184.18) v1(36.96,194.18) v1(36.96,192.18) v1(36.96,190.18) v1(36.96,188.18) v1(36.96,186.18) v1(36.96,184.18) v1(38.46,194.18) v1(38.46,192.18) v1(38.46,190.18) v1(38.46,188.18) v1(38.46,186.18) v1(38.46,184.18) v1(104.91,98.33) v1(223.65,319.19) v1(311.75,197.94)
